# EasyEDA Pro project ProPrj_Starcat_FOC双路矢量控制器_2024-11-11.epro, schematic FOC_cdh_2

## Sheets
1 control: Create Date: 2024-07-30; Page Name: control; Project Name: Starcat_FOC双路矢量控制器; Schematic Name: FOC_cdh_2; Update Date: 2024-07-30
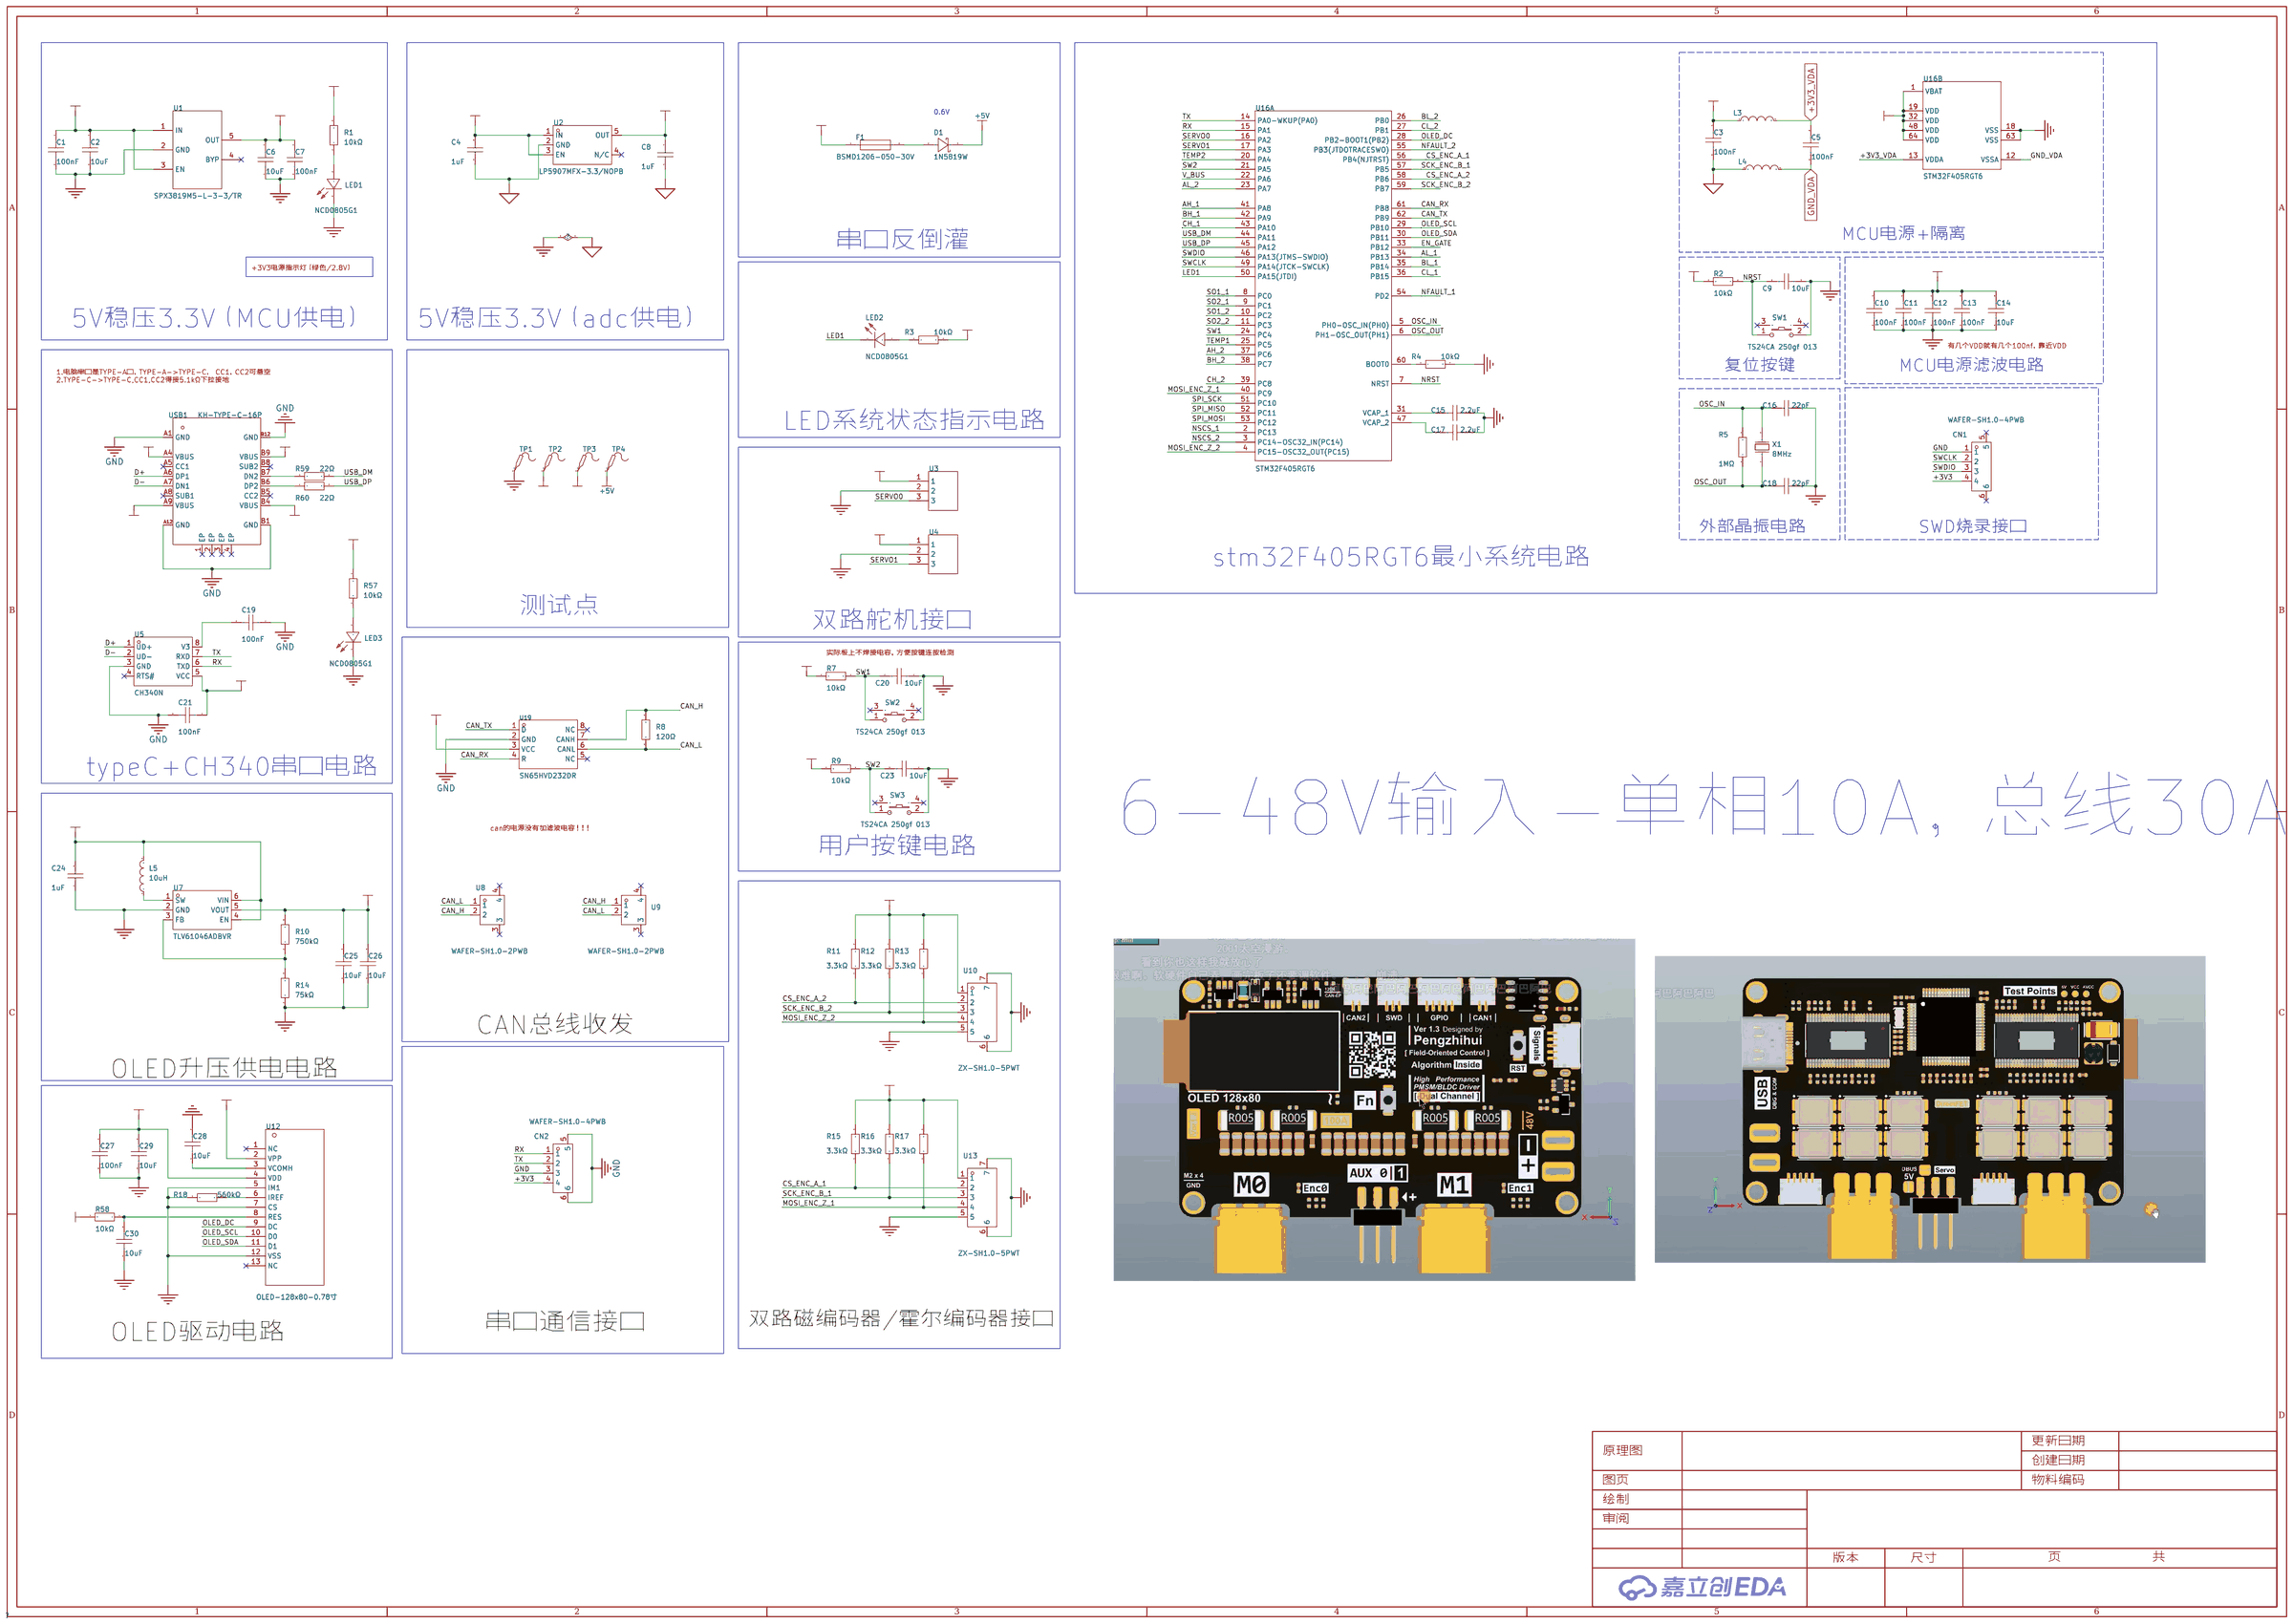
[diagram p1: control]
2 driver: Board Name: 双路大功率矢量控制器_2; Page Name: driver; Update Date: 2024-08-02
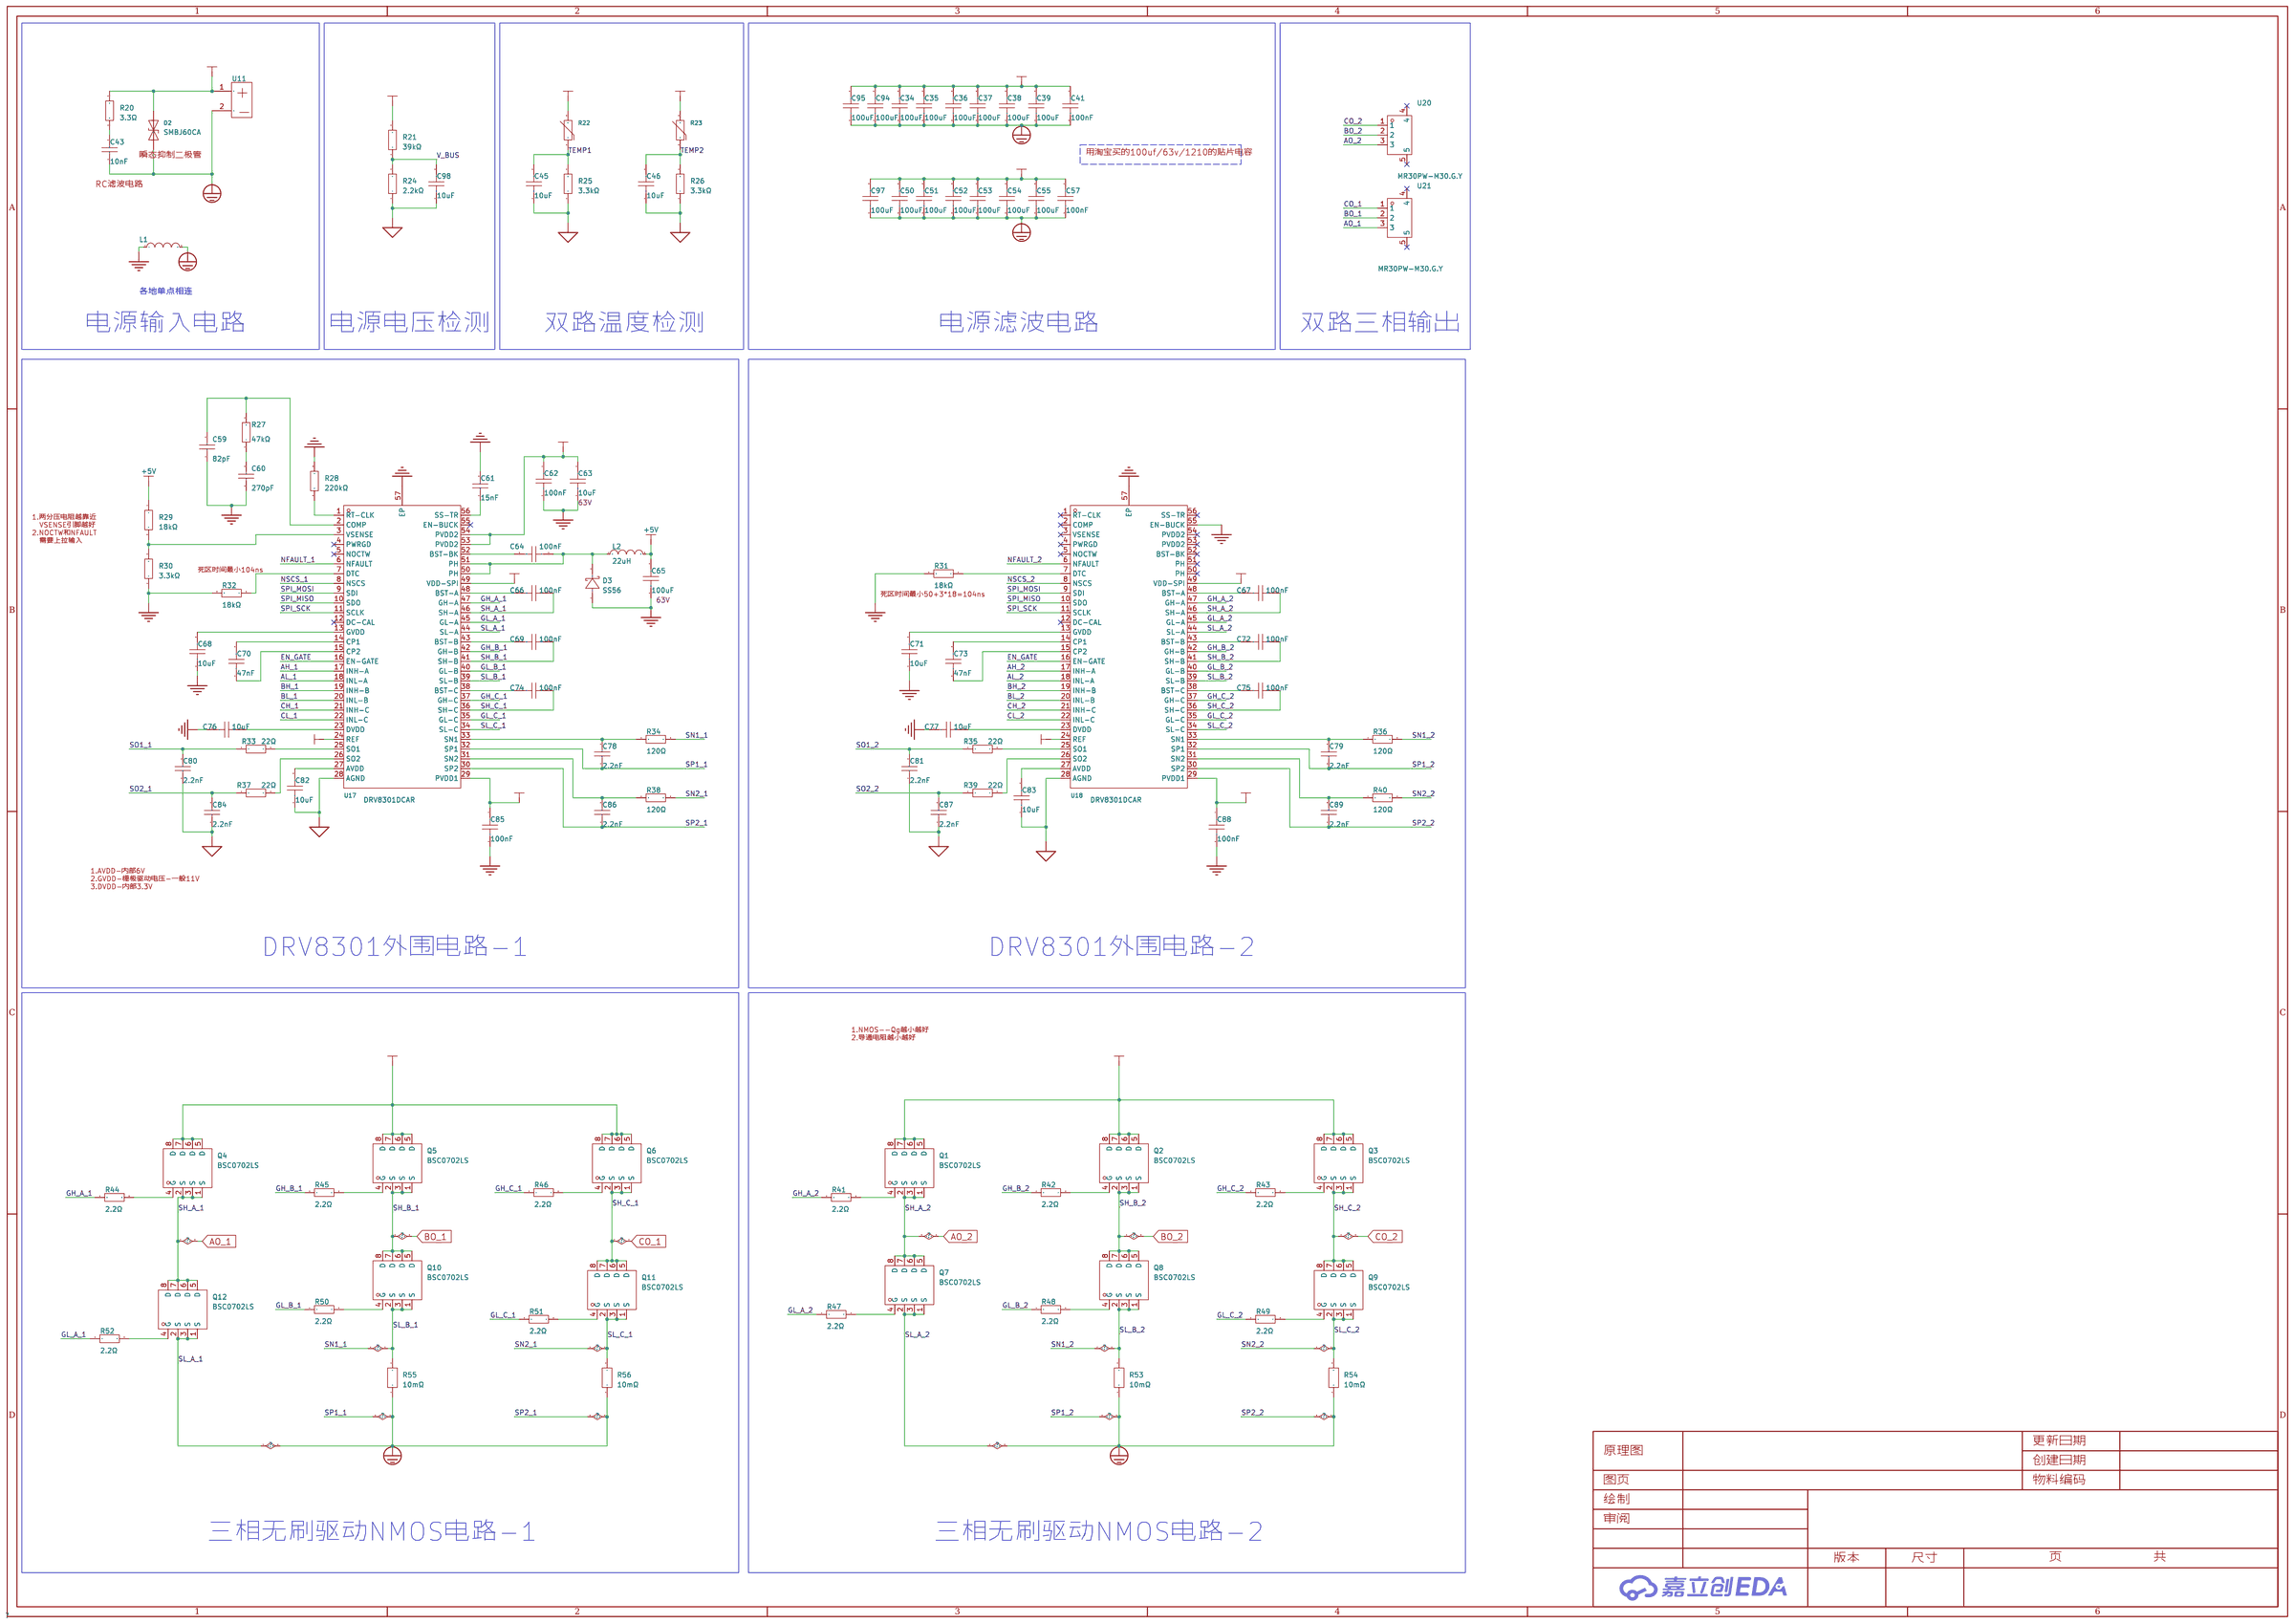
[diagram p2: driver]

## Parts
sheet control
C1  100nF  [C0603]
C2  10uF  [C0603]
C3  100nF  [C0603]
C4  1uF  [C0603]
C5  100nF  [C0603]
C6  10uF  [C0603]
C7  100nF  [C0603]
C8  1uF  [C0603]
C9  10uF  [C0603]
C10  100nF  [C0603]
C11  100nF  [C0603]
C12  100nF  [C0603]
C13  100nF  [C0603]
C14  10uF  [C0603]
C15  2.2uF  [C0603]
C16  22pF  [C0603]
C17  2.2uF  [C0603]
C18  22pF  [C0603]
C19  100nF  [C0603]
C20  10uF  [C0603]
C21  100nF  [C0603]
C23  10uF  [C0603]
C24  1uF  [C0603]
C25  10uF  [C0603]
C26  10uF  [C0603]
C27  100nF  [C0603]
C28  10uF  [C0603]
C29  10uF  [C0603]
C30  10uF  [C0603]
CN1  WAFER-SH1.0-4PWB  [CONN-SMD_4P-P1.00_WAFER-SH1.0-4PWB]
CN2  WAFER-SH1.0-4PWB  [CONN-SMD_4P-P1.00_WAFER-SH1.0-4PWB]
D1  1N5819W  [SOD-123_L2.7-W1.6-LS3.7-R-RD]
F1  BSMD1206-050-30V  [F1206]
L3  CBG160808U000T  [L0603]
L4  CBG160808U000T  [L0603]
L5  10uH  [L0805]
LED1  NCD0805G1  [LED0805-R-RD]
LED2  NCD0805G1  [LED0805-R-RD]
LED3  NCD0805G1  [LED0805-R-RD]
R1  10kΩ  [R0603]
R2  10kΩ  [R0603]
R3  10kΩ  [R0603]
R4  10kΩ  [R0603]
R5  1MΩ  [R0603]
R7  10kΩ  [R0603]
R8  120Ω  [R0603]
R9  10kΩ  [R0603]
R10  750kΩ  [R0603]
R11  3.3kΩ  [R0603]
R12  3.3kΩ  [R0603]
R13  3.3kΩ  [R0603]
R14  75kΩ  [R0603]
R15  3.3kΩ  [R0603]
R16  3.3kΩ  [R0603]
R17  3.3kΩ  [R0603]
R18  560kΩ  [R0603]
R57  10kΩ  [R0603]
R58  10kΩ  [R0603]
R59  22Ω  [R0603]
R60  22Ω  [R0603]
SW1  TS24CA 250gf 013  [SW-SMD_L4.7-W3.5-P3.35-EH]
SW2  TS24CA 250gf 013  [SW-SMD_L4.7-W3.5-P3.35-EH]
SW3  TS24CA 250gf 013  [SW-SMD_L4.7-W3.5-P3.35-EH]
TP1  -  [Test-Point-0.5mm]
TP2  -  [Test-Point-0.5mm]
TP3  -  [Test-Point-0.5mm]
TP4  -  [Test-Point-0.5mm]
U1  SPX3819M5-L-3-3/TR  [SOT-23-5_L3.0-W1.7-P0.95-LS2.8-BL]
U2  LP5907MFX-3.3/NOPB  [SOT-23-5_L3.0-W1.7-P0.95-LS2.8-BR]
U3  -  [舵机接口]
U4  -  [舵机接口]
U5  CH340N  [SOP-8_L4.9-W3.9-P1.27-LS6.0-BL]
U7  TLV61046ADBVR  [SOT-23-6_L2.9-W1.6-P0.95-LS2.8-BL]
U8  WAFER-SH1.0-2PWB  [CONN-SMD_2P-P1.00_XUNPU_WAFER-SH1.0-2PWB]
U9  WAFER-SH1.0-2PWB  [CONN-SMD_2P-P1.00_XUNPU_WAFER-SH1.0-2PWB]
U10  ZX-SH1.0-5PWT  [CONN-SMD_5P-P1.00_MEGASTAR_ZX-SH1.0-5PWT]
U12  OLED-128x80-0.78寸  [oled-128x80-0.78寸]
U13  ZX-SH1.0-5PWT  [CONN-SMD_5P-P1.00_MEGASTAR_ZX-SH1.0-5PWT]
U16  STM32F405RGT6  [LQFP-64_L10.0-W10.0-P0.50-LS12.0-BL]  (sections 1,2)
U19  SN65HVD232DR  [SOIC-8_L5.0-W4.0-P1.27-LS6.0-BL]
USB1  KH-TYPE-C-16P  [USB-C-SMD_KH-TYPE-C-16P]
X1  8MHz  [CRYSTAL-SMD_L5.0-W3.2]
sheet driver
C34  100uF  [C1210]
C35  100uF  [C1210]
C36  100uF  [C1210]
C37  100uF  [C1210]
C38  100uF  [C1210]
C39  100uF  [C1210]
C41  100nF  [C0603]
C43  10nF  [C0603]
C45  10uF  [C0603]
C46  10uF  [C0603]
C50  100uF  [C1210]
C51  100uF  [C1210]
C52  100uF  [C1210]
C53  100uF  [C1210]
C54  100uF  [C1210]
C55  100uF  [C1210]
C57  100nF  [C0603]
C59  82pF  [C0603]
C60  270pF  [C0603]
C61  15nF  [C0603]
C62  100nF  [C0603]
C63  10uF  [C0805]
C64  100nF  [C0603]
C65  100uF  [C1210]
C66  100nF  [C0603]
C67  100nF  [C0603]
C68  10uF  [C0603]
C69  100nF  [C0603]
C70  47nF  [C0603]
C71  10uF  [C0603]
C72  100nF  [C0603]
C73  47nF  [C0603]
C74  100nF  [C0603]
C75  100nF  [C0603]
C76  10uF  [C0603]
C77  10uF  [C0603]
C78  2.2nF  [C0603]
C79  2.2nF  [C0603]
C80  2.2nF  [C0603]
C81  2.2nF  [C0603]
C82  10uF  [C0603]
C83  10uF  [C0603]
C84  2.2nF  [C0603]
C85  100nF  [C0603]
C86  2.2nF  [C0603]
C87  2.2nF  [C0603]
C88  100nF  [C0603]
C89  2.2nF  [C0603]
C94  100uF  [C1210]
C95  100uF  [C1210]
C97  100uF  [C1210]
C98  10uF  [C0603]
D2  SMBJ60CA  [SMB_L4.6-W3.6-LS5.3-BI]
D3  SS56  [SMA_L4.3-W2.6-LS5.0-FD]
L1  CBG160808U000T  [L0603]
L2  22uH  [IND-SMD_L4.0-W4.0]
Q1  BSC0702LS  [PG-TDSON-8_L5.0-W6.0-P1.27-BL-EP]
Q2  BSC0702LS  [PG-TDSON-8_L5.0-W6.0-P1.27-BL-EP]
Q3  BSC0702LS  [PG-TDSON-8_L5.0-W6.0-P1.27-BL-EP]
Q4  BSC0702LS  [PG-TDSON-8_L5.0-W6.0-P1.27-BL-EP]
Q5  BSC0702LS  [PG-TDSON-8_L5.0-W6.0-P1.27-BL-EP]
Q6  BSC0702LS  [PG-TDSON-8_L5.0-W6.0-P1.27-BL-EP]
Q7  BSC0702LS  [PG-TDSON-8_L5.0-W6.0-P1.27-BL-EP]
Q8  BSC0702LS  [PG-TDSON-8_L5.0-W6.0-P1.27-BL-EP]
Q9  BSC0702LS  [PG-TDSON-8_L5.0-W6.0-P1.27-BL-EP]
Q10  BSC0702LS  [PG-TDSON-8_L5.0-W6.0-P1.27-BL-EP]
Q11  BSC0702LS  [PG-TDSON-8_L5.0-W6.0-P1.27-BL-EP]
Q12  BSC0702LS  [PG-TDSON-8_L5.0-W6.0-P1.27-BL-EP]
R20  3.3Ω  [R0603]
R21  39kΩ  [R0603]
R22  NCP18XH103F03RB  [R0603]
R23  NCP18XH103F03RB  [R0603]
R24  2.2kΩ  [R0603]
R25  3.3kΩ  [R0603]
R26  3.3kΩ  [R0603]
R27  47kΩ  [R0603]
R28  220kΩ  [R0603]
R29  18kΩ  [R0603]
R30  3.3kΩ  [R0603]
R31  18kΩ  [R0603]
R32  18kΩ  [R0603]
R33  22Ω  [R0603]
R34  120Ω  [R0603]
R35  22Ω  [R0603]
R36  120Ω  [R0603]
R37  22Ω  [R0603]
R38  120Ω  [R0603]
R39  22Ω  [R0603]
R40  120Ω  [R0603]
R41  2.2Ω  [R0603]
R42  2.2Ω  [R0603]
R43  2.2Ω  [R0603]
R44  2.2Ω  [R0603]
R45  2.2Ω  [R0603]
R46  2.2Ω  [R0603]
R47  2.2Ω  [R0603]
R48  2.2Ω  [R0603]
R49  2.2Ω  [R0603]
R50  2.2Ω  [R0603]
R51  2.2Ω  [R0603]
R52  2.2Ω  [R0603]
R53  10mΩ  [RES-SMD_L6.4-W3.2-R2512]
R54  10mΩ  [RES-SMD_L6.4-W3.2-R2512]
R55  10mΩ  [RES-SMD_L6.4-W3.2-R2512]
R56  10mΩ  [RES-SMD_L6.4-W3.2-R2512]
U11  -  [电源接口]
U17  DRV8301DCAR  [HTSSOP-56_L14.0-W6.0-P0.50-LS8.0-BL]
U18  DRV8301DCAR  [HTSSOP-56_L14.0-W6.0-P0.50-LS8.0-BL]
U20  MR30PW-M30.G.Y  [CONN-TH_MR30PW-M30-G-Y]
U21  MR30PW-M30.G.Y  [CONN-TH_MR30PW-M30-G-Y]

## Library data of the parts
C1 C3 C5 C7 C10-C13 C19 C21 C27 C41 C57 C62 C64 C66 C67 C69 C72 C74 C75 C85 C88 = 0603B104K101NT: 容值:100nF;精度:±10%;额定电压:100V;材质(温度系数):X7R;; LCSC Part Name: 100nF ±10% 100V; Supplier Part: C88219; Manufacturer: FH(风华); Supplier Footprint: 0603; JLCPCB Part Class: 扩展库; Datasheet: https://atta.szlcsc.com/upload/public/pdf/source/20200305/C486355_26A10D38EF8C2A5C37091D0039909270.pdf; Supplier: LCSC; Tolerance: ±10%; Voltage Rated: 100V; Temperature Coefficient: X7R
C2 C6 C9 C14 C20 C23 C25 C26 C28-C30 C45 C46 C68 C71 C76 C77 C82 C83 C98 = CL10A106MA8NRNC: 容值:10uF;精度:±20%;额定电压:25V;材质(温度系数):X5R;; LCSC Part Name: 10uF ±20% 25V; Supplier Part: C96446; Manufacturer: SAMSUNG(三星); Supplier Footprint: 0603; JLCPCB Part Class: 基础库; Datasheet: https://atta.szlcsc.com/upload/public/pdf/source/20160218/1457707763339.pdf; Supplier: LCSC; Tolerance: ±20%; Voltage Rated: 25V; Temperature Coefficient: X5R
C4 C8 C24 = CL10A105KB8NNNC: 容值:1uF;精度:±10%;额定电压:50V;材质(温度系数):X5R;; LCSC Part Name: 1uF ±10% 50V; Supplier Part: C15849; Manufacturer: SAMSUNG(三星); Supplier Footprint: 0603; JLCPCB Part Class: 基础库; Datasheet: https://atta.szlcsc.com/upload/public/pdf/source/20160218/1457707763339.pdf; Supplier: LCSC; Tolerance: ±10%; Voltage Rated: 50V; Temperature Coefficient: X5R
C15 C17 = CL10A225KQ8NNNC: 容值:2.2uF;精度:±10%;额定电压:6.3V;材质(温度系数):X5R;; LCSC Part Name: 2.2uF ±10% 6.3V; Supplier Part: C71000; Manufacturer: SAMSUNG(三星); Supplier Footprint: 0603; JLCPCB Part Class: 扩展库; Datasheet: https://atta.szlcsc.com/upload/public/pdf/source/20191106/C444885_D1DE823F0ED498E02883F0194C396E9C.pdf; Supplier: LCSC; Tolerance: ±10%; Voltage Rated: 6.3V; Temperature Coefficient: X5R
C16 C18 = CL10C220JB8NNNC: 容值:22pF;精度:±5%;额定电压:50V;材质(温度系数):C0G;; LCSC Part Name: 22pF ±5% 50V; Supplier Part: C1653; Manufacturer: SAMSUNG(三星); Supplier Footprint: 0603; JLCPCB Part Class: 基础库; Datasheet: https://atta.szlcsc.com/upload/public/pdf/source/20160218/1457707763339.pdf; Supplier: LCSC; Tolerance: ±5%; Voltage Rated: 50V; Temperature Coefficient: C0G
CN1 CN2 = WAFER-SH1.0-4PWB: 插针结构:1x4P;间距:1mm;安装方式:卧贴;总PIN数:4P;排数:1;每排PIN数:4;额定电流:1A;工作温度范围:-25℃~+85℃;; LCSC Part Name: 1x4P 间距:1mm 卧贴; Supplier Part: C3029343; Manufacturer: XUNPU(讯普); Supplier Footprint: SMD,P=1mm,卧贴; JLCPCB Part Class: 扩展库; Datasheet: https://atta.szlcsc.com/upload/public/pdf/source/20220527/1879B8210BD3B2006BCEAC1A40D397B6.pdf; Supplier: LCSC; Pins Structure: 1x4P; Pitch: 1mm; Mounting Style: 卧贴; Number of Pins: 4P; Number of Rows: 1; Number of PINs Per Row: 4; Current Rating (Max): 1A; Operating Temperature Range: -25℃~+85℃
D1 = 1N5819W_C963381: 二极管配置:独立式;正向压降(Vf):600mV@200mA;直流反向耐压(Vr):40V;平均整流电流(Io):350mA;; LCSC Part Name: 电压:40V 电流:350mA; Supplier Part: C963381; Manufacturer: JSMSEMI(杰盛微); Supplier Footprint: SOD-123; JLCPCB Part Class: 扩展库; Datasheet: https://atta.szlcsc.com/upload/public/pdf/source/20230807/ADD53622154D5B572F84A7B877E922CE.pdf; Supplier: LCSC; Diode Configuration: 独立式; Forward Voltage (Vf@If): 600mV@200mA; Reverse Voltage (Vr): 40V; Average Rectified Current (Io): 350mA; Reverse Leakage Current (Ir): 5uA@30V
F1 = BSMD1206-050-30V: 最大电压:30V;最大电流:40A;保持电流:500mA;跳闸电流:1A;; LCSC Part Name: 30V 500mA 1206自恢复; Supplier Part: C883126; Manufacturer: BHFUSE(佰宏); Supplier Footprint: 1206; JLCPCB Part Class: 扩展库; Datasheet: https://atta.szlcsc.com/upload/public/pdf/source/20230512/E419278EC8529AAF514173EF221BCF4B.pdf; Supplier: LCSC; Operating Voltage (Max): 30V; Current Rating (Max): 40A; Hold Current: 500mA; Trip Current: 1A; Power Dissipation: 800mW; Resistance - Initial (Ri) (Min): 150mΩ; Resistance - Post Trip (R1) (Max): 850mΩ; Maximum Time to Trip: 100ms; Operating Temperature: -40℃~+85℃
L1 L3 L4 = CBG160808U000T: 标称阻抗@测试频率:0Ω@100MHz;直流电阻(RDC):100mΩ;; LCSC Part Name: 单路 0603磁珠 阻抗0Ω@100MHz; Supplier Part: C43163; Manufacturer: FH(风华); Supplier Footprint: 0603; JLCPCB Part Class: 扩展库; Datasheet: https://atta.szlcsc.com/upload/public/pdf/source/20190129/C361667_1614D407CC98D1D3CFBD9E1F7511C14D.pdf; Supplier: LCSC; Impedance @ Frequency: 0Ω@100MHz; DC Resistance: 100mΩ; Current Rating: 800mA; Circuits: 1
L5 = SLM2012100MIT: 电感值:10uH;精度:±20%;额定电流:360mA;饱和电流(Isat):-;; LCSC Part Name: 10uH ±20%; Supplier Part: C2831365; Manufacturer: Sunltech(韩国顺磁); Supplier Footprint: 0805; JLCPCB Part Class: 扩展库; Datasheet: https://atta.szlcsc.com/upload/public/pdf/source/20180528/C216156_746607D01E5EB4C50E0D2BE40685D2FE.pdf; Supplier: LCSC; Tolerance: ±20%; Rated Current: 360mA; DC Resistance (DCR): 550mΩ
LED1-LED3 = NCD0805G1: 发光颜色:翠绿;; LCSC Part Name: 翠绿 0805翠绿  正贴; Supplier Part: C84260; Manufacturer: 国星光电; Supplier Footprint: 0805; JLCPCB Part Class: 扩展库; Datasheet: https://atta.szlcsc.com/upload/public/pdf/source/20200820/C84260_AFC7BF57C6FBA034D182BB8D10A67EFE.pdf; Supplier: LCSC; Emitted Color: 翠绿
R1-R4 R7 R9 R57 R58 = 0603WAF1002T5E: 电阻类型:厚膜电阻;阻值:10kΩ;精度:±1%;功率:100mW;最大工作电压:75V;温度系数:±100ppm/℃;; LCSC Part Name: 厚膜电阻 10kΩ ±1% 100mW; Supplier Part: C25804; Manufacturer: UNI-ROYAL(厚声); Supplier Footprint: 0603; JLCPCB Part Class: 基础库; Datasheet: https://atta.szlcsc.com/upload/public/pdf/source/20200306/C422600_1E6D84923E4A46A82E41ADD87F860B5C.pdf; Supplier: LCSC; Type: 厚膜电阻; Tolerance: ±1%; Power(Watts): 100mW; Overload Voltage (Max): 75V; Temperature Coefficient: ±100ppm/℃; Operating Temperature Range: -55℃~+155℃
R5 = 0603WAF1004T5E: 电阻类型:厚膜电阻;阻值:1MΩ;精度:±1%;功率:100mW;最大工作电压:75V;温度系数:±100ppm/℃;; LCSC Part Name: 1MΩ ±1% 100mW 厚膜电阻; Supplier Part: C22935; Manufacturer: UNI-ROYAL(厚声); Supplier Footprint: 0603; JLCPCB Part Class: 基础库; Datasheet: https://atta.szlcsc.com/upload/public/pdf/source/20200306/C422600_1E6D84923E4A46A82E41ADD87F860B5C.pdf; Supplier: LCSC; Type: 厚膜电阻; Tolerance: ±1%; Power(Watts): 100mW; Overload Voltage (Max): 75V; Temperature Coefficient: ±100ppm/℃; Operating Temperature Range: -55℃~+155℃
R8 R34 R36 R38 R40 = 0603WAF1200T5E: 电阻类型:厚膜电阻;阻值:120Ω;精度:±1%;功率:100mW;; LCSC Part Name: 120Ω ±1% 100mW; Supplier Part: C22787; Manufacturer: UNI-ROYAL(厚声); Supplier Footprint: 0603; JLCPCB Part Class: 基础库; Datasheet: https://atta.szlcsc.com/upload/public/pdf/source/20200306/C422600_1E6D84923E4A46A82E41ADD87F860B5C.pdf; Supplier: LCSC; Type: 厚膜电阻; Tolerance: ±1%; Power(Watts): 100mW; Temperature Coefficient: ±100ppm/℃; Overload Voltage (Max): 75V; Operating Temperature Range: -55℃~+155℃
R10 = 0603WAF7503T5E: 电阻类型:厚膜电阻;阻值:750kΩ;精度:±1%;功率:100mW;最大工作电压:75V;温度系数:±100ppm/℃;; LCSC Part Name: 750kΩ ±1% 100mW 厚膜电阻; Supplier Part: C23240; Manufacturer: UNI-ROYAL(厚声); Supplier Footprint: 0603; JLCPCB Part Class: 扩展库; Datasheet: https://atta.szlcsc.com/upload/public/pdf/source/20200306/C422600_1E6D84923E4A46A82E41ADD87F860B5C.pdf; Supplier: LCSC; Type: 厚膜电阻; Tolerance: ±1%; Power(Watts): 100mW; Overload Voltage (Max): 75V; Temperature Coefficient: ±100ppm/℃; Operating Temperature Range: -55℃~+155℃
R11-R13 R15-R17 R25 R26 R30 = 0603WAF3301T5E: 电阻类型:厚膜电阻;阻值:3.3kΩ;精度:±1%;功率:100mW;最大工作电压:75V;温度系数:±100ppm/℃;; LCSC Part Name: 3.3kΩ ±1% 100mW 厚膜电阻; Supplier Part: C22978; Manufacturer: UNI-ROYAL(厚声); Supplier Footprint: 0603; JLCPCB Part Class: 基础库; Datasheet: https://atta.szlcsc.com/upload/public/pdf/source/20200306/C422600_1E6D84923E4A46A82E41ADD87F860B5C.pdf; Supplier: LCSC; Type: 厚膜电阻; Tolerance: ±1%; Power(Watts): 100mW; Overload Voltage (Max): 75V; Temperature Coefficient: ±100ppm/℃; Operating Temperature Range: -55℃~+155℃
R14 = 0603WAF7502T5E: 电阻类型:厚膜电阻;阻值:75kΩ;精度:±1%;功率:100mW;最大工作电压:75V;温度系数:±100ppm/℃;; LCSC Part Name: 75kΩ ±1% 100mW 厚膜电阻; Supplier Part: C23242; Manufacturer: UNI-ROYAL(厚声); Supplier Footprint: 0603; JLCPCB Part Class: 基础库; Datasheet: https://atta.szlcsc.com/upload/public/pdf/source/20200306/C422600_1E6D84923E4A46A82E41ADD87F860B5C.pdf; Supplier: LCSC; Type: 厚膜电阻; Tolerance: ±1%; Power(Watts): 100mW; Overload Voltage (Max): 75V; Temperature Coefficient: ±100ppm/℃; Operating Temperature Range: -55℃~+155℃